# EasyEDA Pro project PR.eprj, board 新大符2.0（下单PCB） (continued)
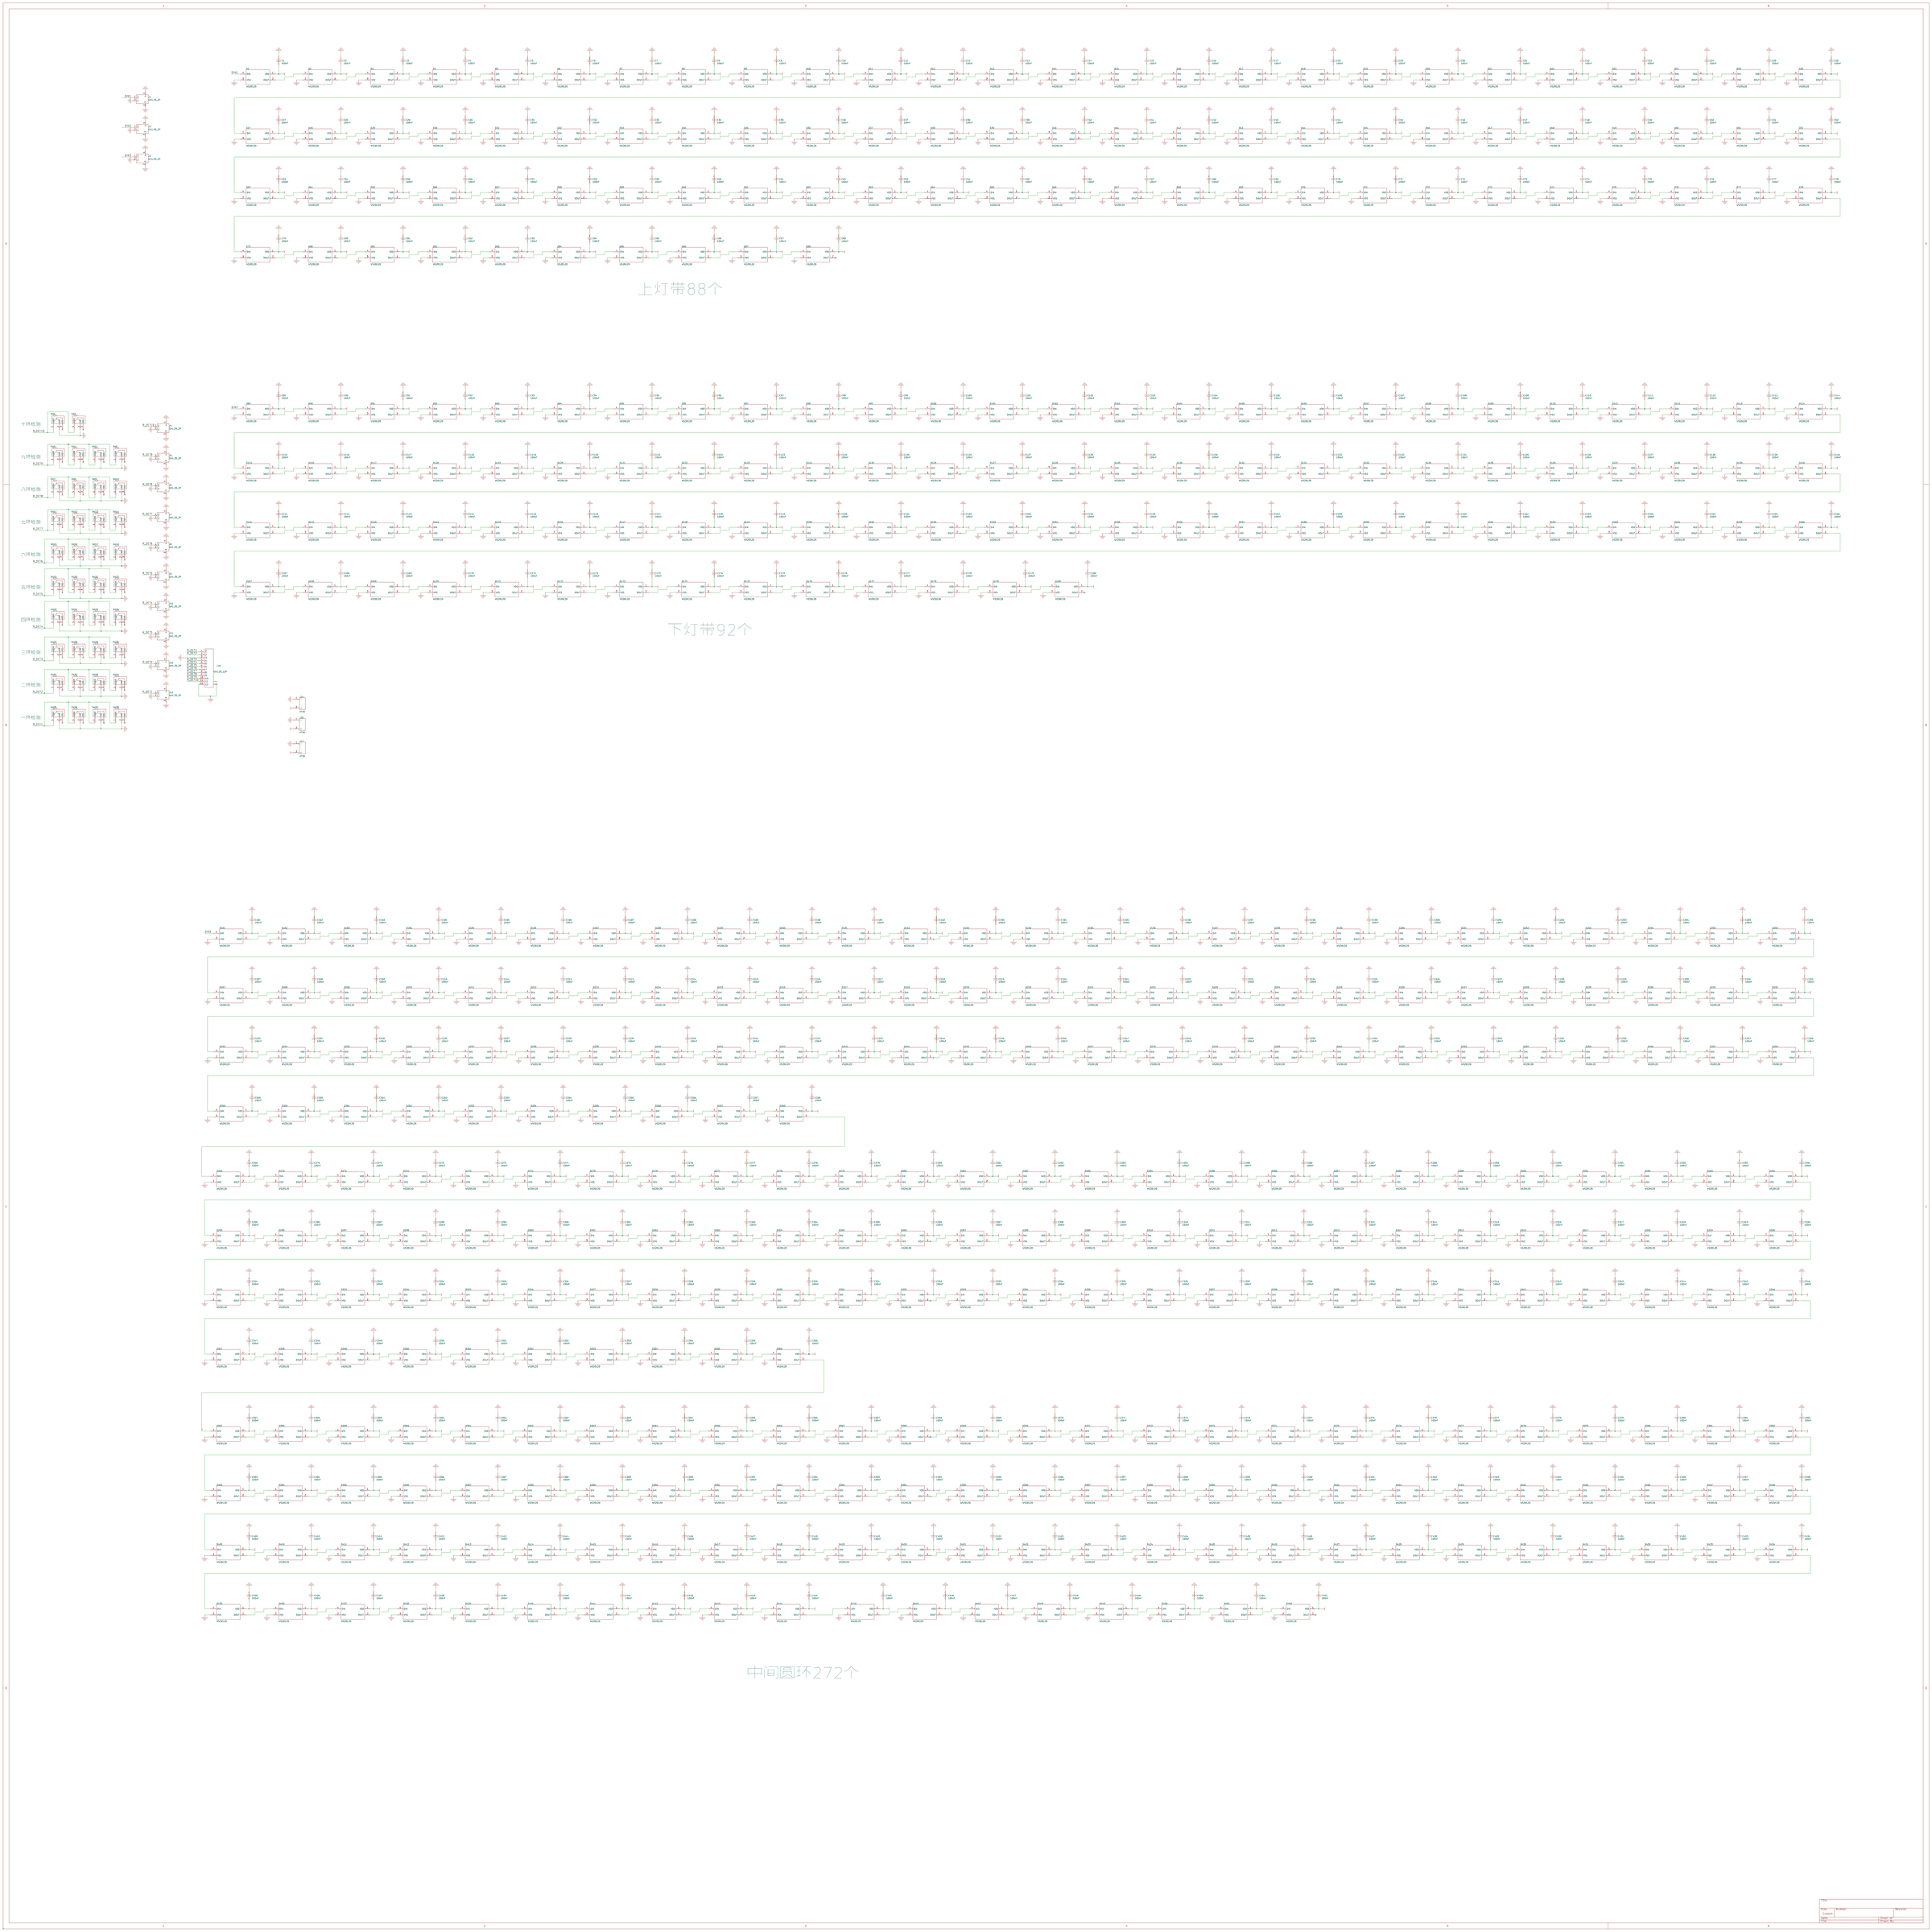
[diagram p0: schematic sheet]
## Placement (name value [footprint] x y rotation side) (continued)
D433  *  [LED-SMD_4P-L5.0-W5.0-TL_WS2812B-B]  223.21 183.48 168 top
D434  *  [LED-SMD_4P-L5.0-W5.0-TL_WS2812B-B]  222.12 193.93 195 top
D435  *  [LED-SMD_4P-L5.0-W5.0-TL_WS2812B-B]  222.88 207.65 285 top
D436  *  [LED-SMD_4P-L5.0-W5.0-TL_WS2812B-B]  203.93 224.78 240 top
D437  *  [LED-SMD_4P-L5.0-W5.0-TL_WS2812B-B]  189.02 229.9 264 top
D438  *  [LED-SMD_4P-L5.0-W5.0-TL_WS2812B-B]  170.56 230.25 15 top
D439  *  [LED-SMD_4P-L5.0-W5.0-TL_WS2812B-B]  152.78 213.74 312 top
D440  *  [LED-SMD_4P-L5.0-W5.0-TL_WS2812B-B]  148.08 204.34 336 top
D441  *  [LED-SMD_4P-L5.0-W5.0-TL_WS2812B-B]  159.64 186.69 105 top
D442  *  [LED-SMD_4P-L5.0-W5.0-TL_WS2812B-B]  174.37 171.83 45 top
D443  *  [LED-SMD_4P-L5.0-W5.0-TL_WS2812B-B]  190.37 165.74 195 top
D444  *  [LED-SMD_4P-L5.0-W5.0-TL_WS2812B-B]  204.49 181.67 135 top
D445  *  [LED-SMD_4P-L5.0-W5.0-TL_WS2812B-B]  210.82 199.26 285 top
D446  *  [LED-SMD_4P-L5.0-W5.0-TL_WS2812B-B]  194.2 214.83 225 top
D447  *  [LED-SMD_4P-L5.0-W5.0-TL_WS2812B-B]  178.05 218.82 15 top
D448  *  [LED-SMD_4P-L5.0-W5.0-TL_WS2812B-B]  164.52 201.95 135 top
D449  *  [LED-SMD_4P-L5.0-W5.0-TL_WS2812B-B]  173.68 192.15 0 top
D450  *  [LED-SMD_4P-L5.0-W5.0-TL_WS2812B-B]  186.44 179.07 180 top
D451  *  [LED-SMD_4P-L5.0-W5.0-TL_WS2812B-B]  195.15 192.39 180 top
D452  *  [LED-SMD_4P-L5.0-W5.0-TL_WS2812B-B]  182.25 205.11 0 top
J1  GH1.25_2P  [GH1.25-LS-2P]  27.91 235.2 180 bottom
J2  GH1.25_2P  [GH1.25-LS-2P]  27.91 153.72 0 bottom
J3  GH1.25_2P  [GH1.25-LS-2P]  31.24 192.53 90 bottom
J4  GH1.25_2P  [GH1.25-LS-2P]  190.63 198.5 270 bottom
J5  GH1.25_2P  [GH1.25-LS-2P]  189.74 214.38 285 bottom
J6  GH1.25_2P  [GH1.25-LS-2P]  181.61 227.84 285 bottom
J7  GH1.25_2P  [GH1.25-LS-2P]  177.29 241.94 285 bottom
J8  GH1.25_2P  [GH1.25-LS-2P]  172.21 251.71 195 bottom
J9  GH1.25_2P  [GH1.25-LS-2P]  168.53 266.45 195 bottom
J10  GH1.25_2P  [GH1.25-LS-2P]  164.72 282.19 195 bottom
J11  GH1.25_2P  [GH1.25-LS-2P]  161.42 296.93 195 bottom
J12  GH1.25_2P  [GH1.25-LS-2P]  157.5 310.76 195 bottom
J13  GH1.25_2P  [GH1.25-LS-2P]  154.05 325.25 195 bottom
J14  XT30  [XT30M]  27.81 216.15 270 bottom
J15  XT30  [XT30M]  27.81 173.74 90 bottom
J17  XT30  [XT30M]  341 194.69 90 bottom
J18  -  [GH1.25_12P]  340.74 214.25 270 bottom
NOREF  -  [Pad_ie425]  126.12 133.97 180 top
NOREF#2  -  [Pad_ie447]  104.9 271.27 90 top
NOREF#3  -  [Pad_ie456]  253.32 261.21 0 top
NOREF#4  -  [Pad_ie458]  274.52 282.27 0 top
NOREF#5  -  [Pad_ie427]  147.32 155.07 180 top
NOREF#6  -  [Pad_ie461]  184.42 192.27 180 top
NOREF#7  -  [Pad_ie422]  94.32 102.27 180 top
NOREF#8  -  [Pad_ie424]  115.52 123.33 180 top
NOREF#9  -  [Pad_ie455]  242.72 250.57 0 top
NOREF#10  -  [Pad_ie460]  306.42 318.26 180 top
NOREF#11  -  [Pad_ie438]  232.12 144.57 270 top
NOREF#12  -  [Pad_ie446]  115.52 261.17 90 top
NOREF#13  -  [Pad_ie435]  200.32 176.37 270 top
NOREF#14  -  [Pad_ie432]  157.73 165.35 180 top
NOREF#15  -  [Pad_ie445]  126.12 250.57 90 top
NOREF#16  -  [Pad_ie423]  104.39 113.28 180 top
NOREF#17  -  [Pad_ie433]  168.52 176.37 180 top
NOREF#18  -  [Pad_ie431]  264.16 112.4 270 top
NOREF#19  -  [Pad_ie440]  253.32 123.37 270 top
NOREF#20  -  [Pad_ie444]  137.03 240.28 90 top
NOREF#21  -  [Pad_ie429]  285.12 91.57 0 top
NOREF#22  -  [Pad_ie453]  221.52 229.47 0 top
NOREF#23  -  [Pad_ie452]  210.92 218.77 0 top
NOREF#24  -  [Pad_ie459]  285.12 293.06 0 top
NOREF#25  -  [Pad_ie450]  62.42 318.26 180 top
NOREF#26  -  [Pad_ie421]  83.72 91.47 180 top
NOREF#27  -  [Pad_ie437]  221.52 155.17 270 top
NOREF#28  -  [Pad_ie451]  200.32 208.17 0 top
NOREF#29  -  [Pad_ie426]  136.72 144.57 180 top
NOREF#30  -  [Pad_ie449]  83.72 292.97 180 top
NOREF#31  -  [Pad_ie448]  94.32 282.37 90 top
NOREF#32  -  [Pad_ie430]  274.52 102.17 270 top
NOREF#33  -  [Pad_ie428]  302.42 60.27 180 top
NOREF#34  -  [Pad_ie457]  264.16 272.03 0 top
NOREF#35  -  [Pad_ie454]  232.12 239.97 0 top
NOREF#36  -  [Pad_ie420]  66.42 60.27 180 top
NOREF#37  -  [Pad_ie434]  184.42 192.27 0 top
NOREF#38  -  [Pad_ie439]  242.72 133.97 270 top
NOREF#39  -  [Pad_ie442]  157.92 218.77 90 top
NOREF#40  -  [Pad_ie436]  210.92 165.77 270 top
NOREF#41  -  [Pad_ie443]  147.32 229.37 90 top
NOREF#42  -  [Pad_ie441]  168.52 208.17 90 top
SW1  Microswitch  [SW-TH_MICROSWITCH]  181.23 199.26 180 top
SW2  Microswitch  [SW-TH_MICROSWITCH]  187.83 184.91 0 top
SW3  Microswitch  [SW-TH_MICROSWITCH]  180.21 213.23 195 top
SW4  Microswitch  [SW-TH_MICROSWITCH]  165.23 188.34 285 top
SW5  Microswitch  [SW-TH_MICROSWITCH]  188.62 171.3 15 top
SW6  Microswitch  [SW-TH_MICROSWITCH]  205.39 196.47 105 top
SW7  Microswitch  [SW-TH_MICROSWITCH]  197.23 159.26 15 top
SW9  Microswitch  [SW-TH_MICROSWITCH]  172.34 224.66 195 top
SW10  Microswitch  [SW-TH_MICROSWITCH]  217.04 205.11 105 top
SW11  Microswitch  [SW-TH_MICROSWITCH]  168.27 239.65 195 top
SW12  Microswitch  [SW-TH_MICROSWITCH]  136.65 175.77 285 top
SW13  Microswitch  [SW-TH_MICROSWITCH]  200.79 144.65 15 top
SW14  Microswitch  [SW-TH_MICROSWITCH]  232.16 207.65 105 top
SW15  Microswitch  [SW-TH_MICROSWITCH]  164.97 254.13 195 top
SW16  Microswitch  [SW-TH_MICROSWITCH]  121.54 172.47 285 top
SW17  Microswitch  [SW-TH_MICROSWITCH]  204.39 130.64 15 top
SW18  Microswitch  [SW-TH_MICROSWITCH]  246.76 212.09 105 top
SW19  Microswitch  [SW-TH_MICROSWITCH]  161.29 268.86 195 top
SW20  Microswitch  [SW-TH_MICROSWITCH]  107.06 168.53 285 top
SW21  Microswitch  [SW-TH_MICROSWITCH]  206.8 115.65 15 top
SW22  Microswitch  [SW-TH_MICROSWITCH]  261.62 215.01 105 top
SW23  Microswitch  [SW-TH_MICROSWITCH]  157.48 284.61 195 top
SW24  Microswitch  [SW-TH_MICROSWITCH]  92.07 164.97 285 top
SW25  Microswitch  [SW-TH_MICROSWITCH]  210.36 101.3 15 top
SW26  Microswitch  [SW-TH_MICROSWITCH]  275.72 218.57 105 top
SW27  Microswitch  [SW-TH_MICROSWITCH]  154.18 299.34 195 top
SW28  Microswitch  [SW-TH_MICROSWITCH]  78.36 161.54 285 top
SW29  Microswitch  [SW-TH_MICROSWITCH]  214.3 86.44 15 top
SW30  Microswitch  [SW-TH_MICROSWITCH]  290.32 222.63 105 top
SW31  Microswitch  [SW-TH_MICROSWITCH]  150.24 313.18 195 top
SW32  Microswitch  [SW-TH_MICROSWITCH]  62.99 158.5 285 top
SW33  Microswitch  [SW-TH_MICROSWITCH]  217.93 71.88 15 top
SW34  Microswitch  [SW-TH_MICROSWITCH]  306.07 226.19 105 top
SW35  Microswitch  [SW-TH_MICROSWITCH]  146.81 327.66 195 top
SW36  Microswitch  [SW-TH_MICROSWITCH]  48.51 154.69 285 top
SW37  Microswitch  [SW-TH_MICROSWITCH]  221.36 57.66 15 top
SW38  Microswitch  [SW-TH_MICROSWITCH]  319.79 229.36 105 top

## Footprints (pads in the part's own frame, mm; a bottom-side part is the same pattern mirrored in y, then rotated)
C_0603
  rect 1x0.9 smd: 1(-0.85,0)
  rect 0.9x1 smd: 2(0.85,0)
C_0603#3
  rect 0.9x1 smd: 1(-0.85,0) 2(0.85,0)
C_0603#4
  rect 0.9x1 smd: 1(-0.85,0)
  rect 1x0.9 smd: 2(0.85,0)
C_0603#2
  rect 0.9x1 smd: 1(-0.85,0) 2(0.85,0)
GH1.25-LS-2P
  rect 0.6x1.702 smd: 1(0.625,1.6) 2(-0.625,1.6)
  rect 1.3x3 smd: 3(-2.575,-1.6) 4(2.575,-1.6)
GH1.25_12P
  rect 0.6x1.7 smd: 1(-6.875,1.675) 2(-5.625,1.675) 3(-4.375,1.675) 4(-3.125,1.675) 5(-1.875,1.675) 6(-0.625,1.675) 7(0.625,1.675) 8(1.875,1.675) 9(3.125,1.675) 10(4.375,1.675) 11(5.625,1.675) 12(6.875,1.675)
  rect 1x2.8 smd: 14(8.726,-1.675) 15(-8.726,-1.675)
LED-SMD_4P-L5.0-W5.0-TL_WS2812B-B
  rect 1.5x1 smd: 1(-2.45,1.65) 2(-2.45,-1.65) 3(2.45,-1.65) 4(2.45,1.65)
LED-SMD_4P-L5.0-W5.0-TL_WS2812B-B#2
  rect 1.5x1 smd: 1(-2.45,1.65) 2(-2.45,-1.65) 3(2.45,-1.65) 4(2.45,1.65)
LED-SMD_4P-L5.0-W5.0-TL_WS2812B-B#3
  rect 1.5x1 smd: 1(-2.45,1.65) 2(-2.45,-1.65) 3(2.45,-1.65) 4(2.45,1.65)
LED-SMD_4P-L5.0-W5.0-TL_WS2812B-B#4
  rect 1.5x1 smd: 1(-2.45,1.65) 2(-2.45,-1.65) 3(2.45,-1.65) 4(2.45,1.65)
LED-SMD_4P-L5.0-W5.0-TL_WS2812B-B#5
  rect 1.5x1 smd: 1(-2.45,1.65) 2(-2.45,-1.65) 3(2.45,-1.65) 4(2.45,1.65)
Pad_ie420
  round 6 hole 5.2: 1(0,0)
Pad_ie421
  round 6 hole 5.2: 1(0,0)
Pad_ie422
  round 6 hole 5.2: 1(0,0)
Pad_ie423
  round 6 hole 5.2: 1(0,0)
Pad_ie424
  round 6 hole 5.2: 1(0,0)
Pad_ie425
  round 6 hole 5.2: 1(0,0)
Pad_ie426
  round 6 hole 5.2: 1(0,0)
Pad_ie427
  round 6 hole 5.2: 1(0,0)
Pad_ie428
  round 6 hole 5.2: 1(0,0)
Pad_ie429
  round 6 hole 5.2: 1(0,0)
Pad_ie430
  round 6 hole 5.2: 1(0,0)
Pad_ie431
  round 6 hole 5.2: 1(0,0)
Pad_ie432
  round 6 hole 5.2: 1(0,0)
Pad_ie433
  round 6 hole 5.2: 1(0,0)
Pad_ie434
  round 6 hole 5.2: 1(0,0)
Pad_ie435
  round 6 hole 5.2: 1(0,0)
Pad_ie436
  round 6 hole 5.2: 1(0,0)
Pad_ie437
  round 6 hole 5.2: 1(0,0)
Pad_ie438
  round 6 hole 5.2: 1(0,0)
Pad_ie439
  round 6 hole 5.2: 1(0,0)
Pad_ie440
  round 6 hole 5.2: 1(0,0)
Pad_ie441
  round 6 hole 5.2: 1(0,0)
Pad_ie442
  round 6 hole 5.2: 1(0,0)
Pad_ie443
  round 6 hole 5.2: 1(0,0)
Pad_ie444
  round 6 hole 5.2: 1(0,0)
Pad_ie445
  round 6 hole 5.2: 1(0,0)
Pad_ie446
  round 6 hole 5.2: 1(0,0)
Pad_ie447
  round 6 hole 5.2: 1(0,0)
Pad_ie448
  round 6 hole 5.2: 1(0,0)
Pad_ie449
  round 6 hole 5.2: 1(0,0)
Pad_ie450
  round 6 hole 5.2: 1(0,0)
Pad_ie451
  round 6 hole 5.2: 1(0,0)
Pad_ie452
  round 6 hole 5.2: 1(0,0)
Pad_ie453
  round 6 hole 5.2: 1(0,0)
Pad_ie454
  round 6 hole 5.2: 1(0,0)
Pad_ie455
  round 6 hole 5.2: 1(0,0)
Pad_ie456
  round 6 hole 5.2: 1(0,0)
Pad_ie457
  round 6 hole 5.2: 1(0,0)
Pad_ie458
  round 6 hole 5.2: 1(0,0)
Pad_ie459
  round 6 hole 5.2: 1(0,0)
Pad_ie460
  round 6 hole 5.2: 1(0,0)
Pad_ie461
  round 8 smd far side: tdr(0,0)
SW-TH_MICROSWITCH
  oval 2.2x1.5 hole 1.8x1: 1(-5.079,0) 2(0.001,0) 3(5.081,0)
XT30M
  round 3.5 hole 2.6: 1(-2.5,0) 2(2.5,0)

## Nets
As in the schematic, except:
GND: .2 C1.2 C2.2 C3.2 C4.2 C5.2 C6.2 C7.2 C8.2 C9.2 C10.2 C11.2 C12.2 C13.2 C14.2 C15.2 C16.2 C17.2 C18.2 C19.2 C20.2 C21.2 C22.2 C23.2 C24.2 C25.2 C26.2 C27.2 C28.2 C29.2 C30.2 C31.2 C32.2 C33.2 C34.2 C35.2 C36.2 C37.2 C38.2 C39.2 C40.2 C41.2 C42.2 C43.2 C44.2 C45.2 C46.2 C47.2 C48.2 C49.2 C50.2 C51.2 C52.2 C53.2 C54.2 C55.2 C56.2 C57.2 C58.2 C59.2 C60.2 C61.2 C62.2 C63.2 C64.2 C65.2 C66.2 C67.2 C68.2 C69.2 C70.2 C71.2 C72.2 C73.2 C74.2 C75.2 C76.2 C77.2 C78.2 C79.2 C80.2 C81.2 C82.2 C83.2 C84.2 C85.2 C86.2 C87.2 C88.2 C89.2 C90.2 C91.2 C92.2 C93.2 C94.2 C95.2 C96.2 C97.2 C98.2 C99.2 C100.2 C101.2 C102.2 C103.2 C104.2 C105.2 C106.2 C107.2 C108.2 C109.2 C110.2 C111.2 C112.2 C113.2 C114.2 C115.2 C116.2 C117.2 C118.2 C119.2 C120.2 C121.2 C122.2 C123.2 C124.2 C125.2 C126.2 C127.2 C128.2 C129.2 C130.2 C131.2 C132.2 C133.2 C134.2 C135.2 C136.2 C137.2 C138.2 C139.2 C140.2 C141.2 C142.2 C143.2 C144.2 C145.2 C146.2 C147.2 C148.2 C149.2 C150.2 C151.2 C152.2 C153.2 C154.2 C155.2 C156.2 C157.2 C158.2 C159.2 C160.2 C161.2 C162.2 C163.2 C164.2 C165.2 C166.2 C167.2 C168.2 C169.2 C170.2 C171.2 C172.2 C173.2 C174.2 C175.2 C176.2 C177.2 C178.2 C179.2 C180.2 C181.2 C182.2 C183.2 C184.2 C185.2 C186.2 C187.2 C188.2 C189.2 C190.2 C191.2 C192.2 C193.2 C194.2 C195.2 C196.2 C197.2 C198.2 C199.2 C200.2 C201.2 C202.2 C203.2 C204.2 C205.2 C206.2 C207.2 C208.2 C209.2 C210.2 C211.2 C212.2 C213.2 C214.2 C215.2 C216.2 C217.2 C218.2 C219.2 C220.2 C221.2 C222.2 C223.2 C224.2 C225.2 C226.2 C227.2 C228.2 C229.2 C230.2 C231.2 C232.2 C233.2 C234.2 C235.2 C236.2 C237.2 C238.2 C239.2 C240.2 C241.2 C242.2 C243.2 C244.2 C245.2 C246.2 C247.2 C248.2 C249.2 C250.2 C251.2 C252.2 C253.2 C254.2 C255.2 C256.2 C257.2 C258.2 C259.2 C260.2 C261.2 C262.2 C263.2 C264.2 C265.2 C266.2 C267.2 C268.2 C269.2 C270.2 C271.2 C272.2 C273.2 C274.2 C275.2 C276.2 C277.2 C278.2 C279.2 C280.2 C281.2 C282.2 C283.2 C284.2 C285.2 C286.2 C287.2 C288.2 C289.2 C290.2 C291.2 C292.2 C293.2 C294.2 C295.2 C296.2 C297.2 C298.2 C299.2 C300.2 C301.2 C302.2 C303.2 C304.2 C305.2 C306.2 C307.2 C308.2 C309.2 C310.2 C311.2 C312.2 C313.2 C314.2 C315.2 C316.2 C317.2 C318.2 C319.2 C320.2 C321.2 C322.2 C323.2 C324.2 C325.2 C326.2 C327.2 C328.2 C329.2 C330.2 C331.2 C332.2 C333.2 C334.2 C335.2 C336.2 C337.2 C338.2 C339.2 C340.2 C341.2 C342.2 C343.2 C344.2 C345.2 C346.2 C347.2 C348.2 C349.2 C350.2 C351.2 C352.2 C353.2 C354.2 C355.2 C356.2 C357.2 C358.2 C359.2 C360.2 C361.2 C362.2 C363.2 C364.2 C365.2 C366.2 C367.2 C368.2 C369.2 C370.2 C371.2 C372.2 C373.2 C374.2 C375.2 C376.2 C377.2 C378.2 C379.2 C380.2 C381.2 C382.2 C383.2 C384.2 C385.2 C386.2 C387.2 C388.2 C389.2 C390.2 C391.2 C392.2 C393.2 C394.2 C395.2 C396.2 C397.2 C398.2 C399.2 C400.2 C401.2 C402.2 C403.2 C404.2 C405.2 C406.2 C407.2 C408.2 C409.2 C410.2 C411.2 C412.2 C413.2 C414.2 C415.2 C416.2 C417.2 C418.2 C419.2 C420.2 C421.2 C422.2 C423.2 C424.2 C425.2 C426.2 C427.2 C428.2 C429.2 C430.2 C431.2 C432.2 C433.2 C434.2 C435.2 C436.2 C437.2 C438.2 C439.2 C440.2 C441.2 C442.2 C443.2 C444.2 C445.2 C446.2 C447.2 C448.2 C449.2 C450.2 C451.2 C452.2 D1.3 D2.3 D3.3 D4.3 D5.3 D6.3 D7.3 D8.3 D9.3 D10.3 D11.3 D12.3 D13.3 D14.3 D15.3 D16.3 D17.3 D18.3 D19.3 D20.3 D21.3 D22.3 D23.3 D24.3 D25.3 D26.3 D27.3 D28.3 D29.3 D30.3 D31.3 D32.3 D33.3 D34.3 D35.3 D36.3 D37.3 D38.3 D39.3 D40.3 D41.3 D42.3 D43.3 D44.3 D45.3 D46.3 D47.3 D48.3 D49.3 D50.3 D51.3 D52.3 D53.3 D54.3 D55.3 D56.3 D57.3 D58.3 D59.3 D60.3 D61.3 D62.3 D63.3 D64.3 D65.3 D66.3 D67.3 D68.3 D69.3 D70.3 D71.3 D72.3 D73.3 D74.3 D75.3 D76.3 D77.3 D78.3 D79.3 D80.3 D81.3 D82.3 D83.3 D84.3 D85.3 D86.3 D87.3 D88.3 D89.3 D90.3 D91.3 D92.3 D93.3 D94.3 D95.3 D96.3 D97.3 D98.3 D99.3 D100.3 D101.3 D102.3 D103.3 D104.3 D105.3 D106.3 D107.3 D108.3 D109.3 D110.3 D111.3 D112.3 D113.3 D114.3 D115.3 D116.3 D117.3 D118.3 D119.3 D120.3 D121.3 D122.3 D123.3 D124.3 D125.3 D126.3 D127.3 D128.3 D129.3 D130.3 D131.3 D132.3 D133.3 D134.3 D135.3 D136.3 D137.3 D138.3 D139.3 D140.3 D141.3 D142.3 D143.3 D144.3 D145.3 D146.3 D147.3 D148.3 D149.3 D150.3 D151.3 D152.3 D153.3 D154.3 D155.3 D156.3 D157.3 D158.3 D159.3 D160.3 D161.3 D162.3 D163.3 D164.3 D165.3 D166.3 D167.3 D168.3 D169.3 D170.3 D171.3 D172.3 D173.3 D174.3 D175.3 D176.3 D177.3 D178.3 D179.3 D180.3 D181.3 D182.3 D183.3 D184.3 D185.3 D186.3 D187.3 D188.3 D189.3 D190.3 D191.3 D192.3 D193.3 D194.3 D195.3 D196.3 D197.3 D198.3 D199.3 D200.3 D201.3 D202.3 D203.3 D204.3 D205.3 D206.3 D207.3 D208.3 D209.3 D210.3 D211.3 D212.3 D213.3 D214.3 D215.3 D216.3 D217.3 D218.3 D219.3 D220.3 D221.3 D222.3 D223.3 D224.3 D225.3 D226.3 D227.3 D228.3 D229.3 D230.3 D231.3 D232.3 D233.3 D234.3 D235.3 D236.3 D237.3 D238.3 D239.3 D240.3 D241.3 D242.3 D243.3 D244.3 D245.3 D246.3 D247.3 D248.3 D249.3 D250.3 D251.3 D252.3 D253.3 D254.3 D255.3 D256.3 D257.3 D258.3 D259.3 D260.3 D261.3 D262.3 D263.3 D264.3 D265.3 D266.3 D267.3 D268.3 D269.3 D270.3 D271.3 D272.3 D273.3 D274.3 D275.3 D276.3 D277.3 D278.3 D279.3 D280.3 D281.3 D282.3 D283.3 D284.3 D285.3 D286.3 D287.3 D288.3 D289.3 D290.3 D291.3 D292.3 D293.3 D294.3 D295.3 D296.3 D297.3 D298.3 D299.3 D300.3 D301.3 D302.3 D303.3 D304.3 D305.3 D306.3 D307.3 D308.3 D309.3 D310.3 D311.3 D312.3 D313.3 D314.3 D315.3 D316.3 D317.3 D318.3 D319.3 D320.3 D321.3 D322.3 D323.3 D324.3 D325.3 D326.3 D327.3 D328.3 D329.3 D330.3 D331.3 D332.3 D333.3 D334.3 D335.3 D336.3 D337.3 D338.3 D339.3 D340.3 D341.3 D342.3 D343.3 D344.3 D345.3 D346.3 D347.3 D348.3 D349.3 D350.3 D351.3 D352.3 D353.3 D354.3 D355.3 D356.3 D357.3 D358.3 D359.3 D360.3 D361.3 D362.3 D363.3 D364.3 D365.3 D366.3 D367.3 D368.3 D369.3 D370.3 D371.3 D372.3 D373.3 D374.3 D375.3 D376.3 D377.3 D378.3 D379.3 D380.3 D381.3 D382.3 D383.3 D384.3 D385.3 D386.3 D387.3 D388.3 D389.3 D390.3 D391.3 D392.3 D393.3 D394.3 D395.3 D396.3 D397.3 D398.3 D399.3 D400.3 D401.3 D402.3 D403.3 D404.3 D405.3 D406.3 D407.3 D408.3 D409.3 D410.3 D411.3 D412.3 D413.3 D414.3 D415.3 D416.3 D417.3 D418.3 D419.3 D420.3 D421.3 D422.3 D423.3 D424.3 D425.3 D426.3 D427.3 D428.3 D429.3 D430.3 D431.3 D432.3 D433.3 D434.3 D435.3 D436.3 D437.3 D438.3 D439.3 D440.3 D441.3 D442.3 D443.3 D444.3 D445.3 D446.3 D447.3 D448.3 D449.3 D450.3 D451.3 D452.3 J1.2 J1.3 J1.4 J2.2 J2.3 J2.4 J3.2 J3.3 J3.4 J4.2 J4.3 J4.4 J5.2 J5.3 J5.4 J6.2 J6.3 J6.4 J7.2 J7.3 J7.4 J8.2 J8.3 J8.4 J9.2 J9.3 J9.4 J10.2 J10.3 J10.4 J11.2 J11.3 J11.4 J12.2 J12.3 J12.4 J13.2 J13.3 J13.4 J14.1 J15.1 J17.1 J18.3 J18.12 J18.14 J18.15 SW1.2 SW2.2 SW3.2 SW4.2 SW5.2 SW6.2 SW7.2 SW9.2 SW10.2 SW11.2 SW12.2 SW13.2 SW14.2 SW15.2 SW16.2 SW17.2 SW18.2 SW19.2 SW20.2 SW21.2 SW22.2 SW23.2 SW24.2 SW25.2 SW26.2 SW27.2 SW28.2 SW29.2 SW30.2 SW31.2 SW32.2 SW33.2 SW34.2 SW35.2 SW36.2 SW37.2 SW38.2
R_DET8: .1 J6.1 J18.9 SW7.1 SW9.1 SW10.1

Pads without a net:  3; NOREF 1; NOREF#2 1; NOREF#3 1; NOREF#4 1; NOREF#5 1; NOREF#6 tdr; NOREF#7 1; NOREF#8 1; NOREF#9 1; NOREF#10 1; NOREF#11 1; NOREF#12 1; NOREF#13 1; NOREF#14 1; NOREF#15 1; NOREF#16 1; NOREF#17 1; NOREF#18 1; NOREF#19 1; NOREF#20 1; NOREF#21 1; NOREF#22 1; NOREF#23 1; NOREF#24 1; NOREF#25 1; NOREF#26 1; NOREF#27 1; NOREF#28 1; NOREF#29 1; NOREF#30 1; NOREF#31 1; NOREF#32 1; NOREF#33 1; NOREF#34 1; NOREF#35 1; NOREF#36 1; NOREF#37 1; NOREF#38 1; NOREF#39 1; NOREF#40 1; NOREF#41 1; NOREF#42 1; SW1 3; SW2 3; SW3 3; SW4 3; SW5 3; SW6 3; SW7 3; SW9 3; SW10 3; SW11 3; SW12 3; SW13 3; SW14 3; SW15 3; SW16 3; SW17 3; SW18 3; SW19 3; SW20 3; SW21 3; SW22 3; SW23 3; SW24 3; SW25 3; SW26 3; SW27 3; SW28 3; SW29 3; SW30 3; SW31 3; SW32 3; SW33 3; SW34 3; SW35 3; SW36 3; SW37 3; SW38 3

## Via types
v1: diameter 0.711, hole 0.355, Top Layer to Bottom Layer, 46 vias
v2: diameter 0.508, hole 0.305, Top Layer to Bottom Layer, 2 vias
v3: diameter 1.1, hole 0.7, Top Layer to Bottom Layer, 452 vias

## Routing (per net, layer and track width the routed paths; a pad name or vN(x,y) marks a point on that pad's centre or on a via; arc(x,y) is an arc through that point)
GND: length 38.5
  Top Layer w0.508: C105.2 322.94,64.52 320.26,65.5 arc(320.18,65.53) 320.11,65.58 ; 320.11,65.58 317.03,68.05 D165.3 ; 191.52,179.83 C443.2 191.52,179.47 186.84,179.33 arc(186.69,179.35) 186.55,179.41 ; 186.55,179.41 184.48,180.73 183.99,180.97
  Bottom Layer w0.508: J2.2 27.23,152.72 25.73,154.08 v1(25.33,155.32) v1(30.48,155.32) ; v1(29.64,189.96) 30.89,190.35 32.24,191.86 J3.2 ; v2(25.33,233.6) v1(30.48,233.6) 30.08,234.85 28.58,236.21 J1.2
  vias: v1(27.91,233.6) v1(27.91,155.32) v1(29.64,195.11) v1(29.72,192.66) v1(152.02,322.83) v1(154.52,323.6) v1(155.45,308.74) v1(156.95,324.37) v1(157.73,309.25) v1(159.34,294.71) v1(160.4,310.01) v1(161.93,295.28) v1(162.69,279.78) v1(164.97,280.42) v1(166.46,264.23) v1(167.62,281.31) v1(168.91,264.92) v1(170.14,249.5) v1(171.43,265.57) v1(172.59,250.06) v1(175.11,250.84) v1(178.17,244.84) v1(178.82,242.32) v1(179.45,240.03) v1(182.49,230.74) v1(183.13,228.35) v1(183.82,225.77) v1(190.62,217.28) v1(191.26,214.76) v1(191.95,212.3) v1(192.15,198.37) v1(192.23,201.08) v1(192.23,195.93) v1(342.52,220.47) v1(342.52,218.06) v1(342.52,215.65) v1(342.52,213.23) v1(342.52,210.82) v1(342.52,208.41) v1(342.52,205.99)
VCC: length 997.2
  Top Layer w0.508: C17.1 241.86,342.66 ; 30.66,275.77 C43.1 ; C433.1 145.74,172.49 ; D437.1 190.92,232.34 ; 242.36,344.02 v3(242.59,344.46) 242.59,344.3 ; v3(323.65,40.82) 323.8,40.67 ; 159.12,15.99 arc(159.13,15.93) C166.1 ; 187.07,4.4 arc(187.08,4.36) C155.1 ; C54.1 arc(177.4,348.21) 177.42,348.32 ; C125.1 arc(201.64,4.52) 201.66,4.62 ; C24.1 arc(264.51,361.61) 264.69,362.52 ; 172.49,4.48 arc(172.49,4.46) C124.1 ; 191.9,359.76 arc(191.91,359.71) C67.1 ; 151.22,349.54 arc(151.28,349.27) 151.43,349.05 ; C161.1 arc(187.45,16) 187.48,16.16 ; C47.1 arc(47.57,330.11) 47.45,330.29 ; 218.82,348.58 arc(218.83,348.53) C80.1 ; 164.76,361.69 arc(164.75,361.74) D41.1 ; C162.1 arc(201.64,15.95) 201.66,16.05 ; 219.33,360.77 arc(219.34,360.72) C74.1 ; 218.95,371.06 arc(218.96,371.01) C55.1 ; 205.11,370.93 arc(205.12,370.88) C65.1 ; 164.72,370.3 arc(164.73,370.25) C64.1 ; 205.11,359.88 arc(205.12,359.83) C70.1 ; 150.08,359.77 arc(150.1,359.67) C59.1 ; 177.93,370.68 arc(177.94,370.63) C63.1 ; 173.12,27.62 arc(173.12,27.59) C160.1 ; C120.1 arc(201.64,27.51) 201.66,27.61 ; C140.1 arc(358.07,83.17) 357.12,83.36 ; 191.9,348.33 arc(191.91,348.28) C61.1 ; 192.02,370.68 arc(192.03,370.63) C66.1 ; 148.94,370.62 arc(148.99,370.36) C69.1 ; 205.62,348.58 arc(205.62,348.53) C58.1 ; D100.1 arc(12.92,71.07) 12.91,71.07 ; C68.1 arc(177.65,359.38) 177.67,359.5 ; C164.1 arc(173.29,15.91) 173.3,15.96 ; 164.34,348.83 arc(164.35,348.78) 164.38,348.74 ; C163.1 arc(186.88,27.6) 186.89,27.64